# EasyEDA Pro project NFC1.eprj (continued)
## Text on the board (continued)
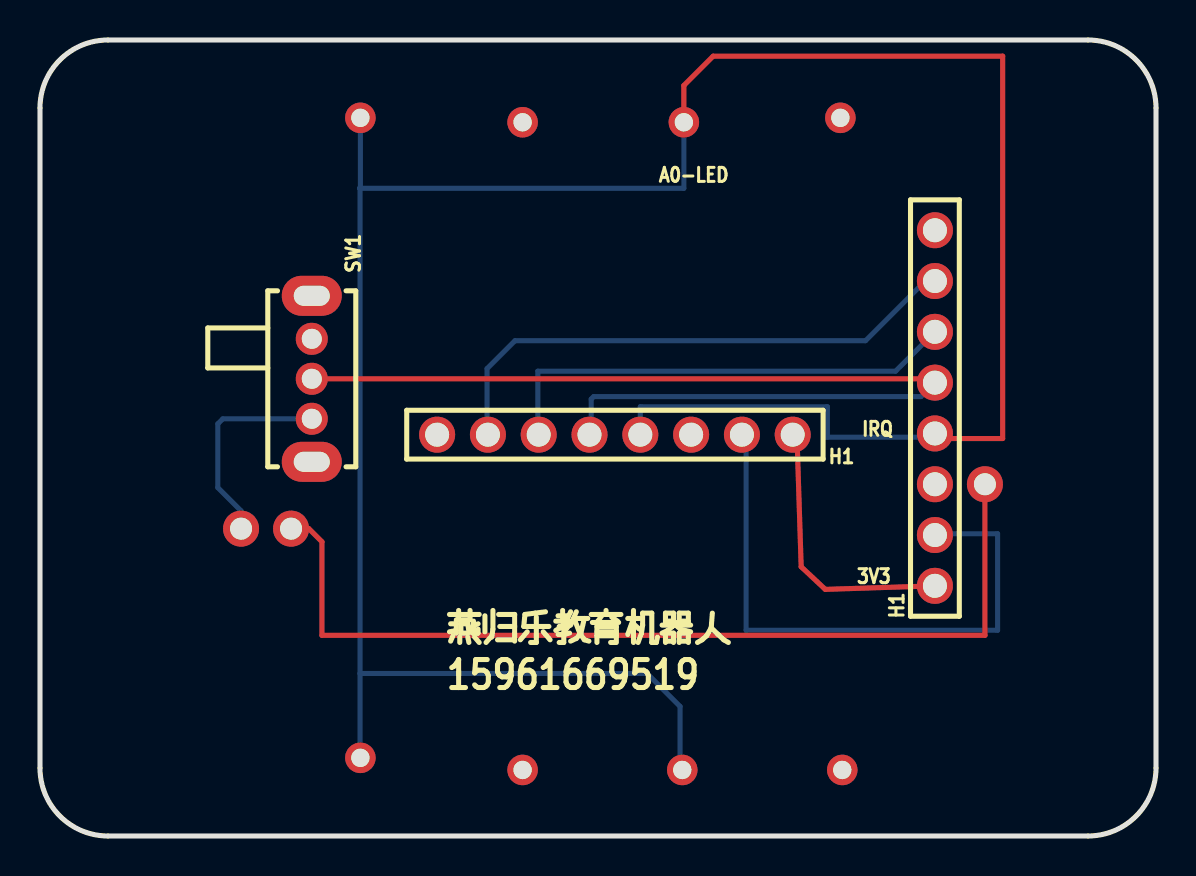
[diagram p2: board, top side]
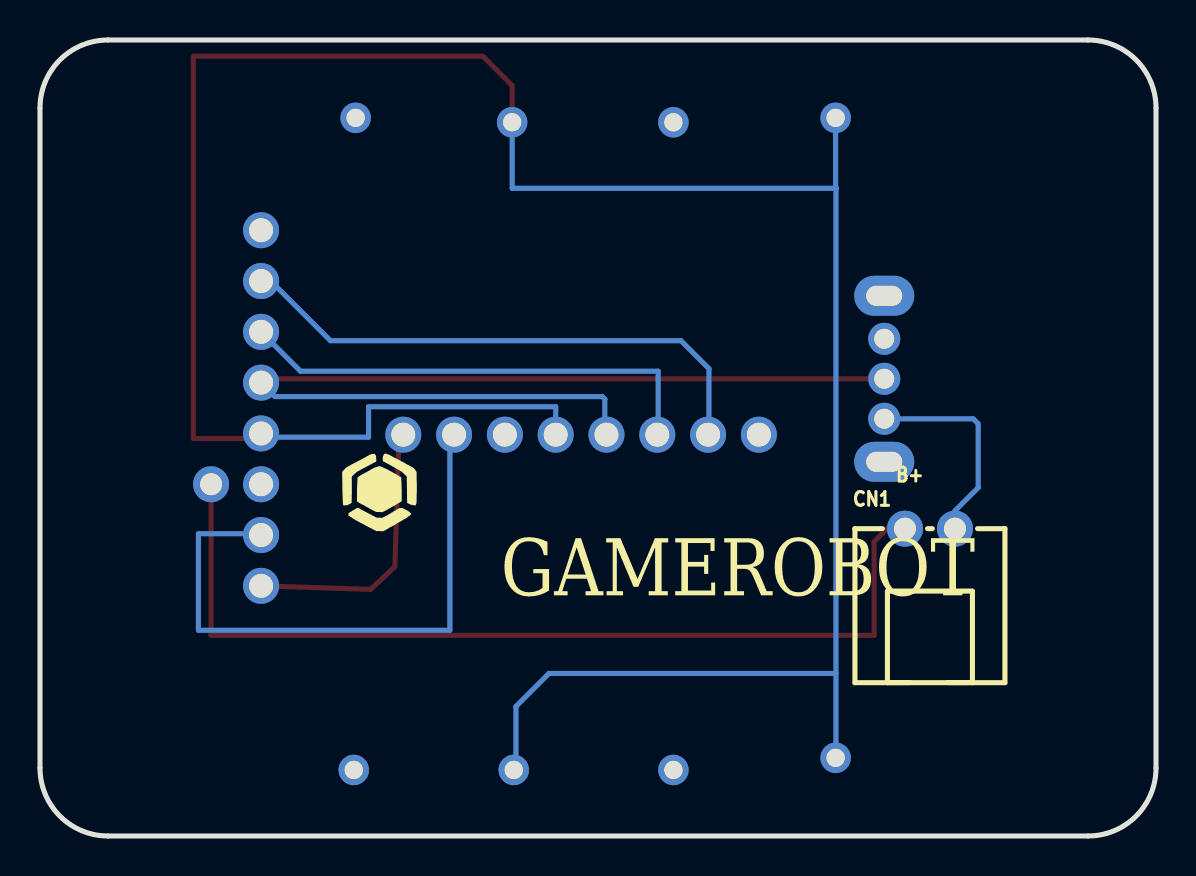
[diagram p3: board, bottom side, seen from below]

Outline 55.8 x 39.8 mm; copper layers: Top Layer, Bottom Layer. Coordinates in mm from the lower left corner of the outline.
Outline path: 0,36.4 0,3.4 arc(1,1) 3.4,0 52.4,0 arc(54.8,1) 55.8,3.4 55.8,36.4 arc(54.8,38.8) 52.4,39.8 3.4,39.8 arc(1,38.8) 0,36.4
Stack: Top Layer 0.035mm / Dielectric1 1.51mm FR4 er 4.5 / Bottom Layer 0.035mm

## Design rules (mm)
template: JLCPCB Capability(Two Layers Board)
spacing copperThickness1oz (default): track to track 0.102, other pairs 0.152 to 0.3
spacing copperThickness2oz: track to track 0.203, other pairs 0.152 to 0.3
track width copperThickness1oz (default): min 0.127, default 0.254, max 2.54
track width copperThickness2oz: min 0.203, default 0.254, max 2.54
differential pair differentialPair (default): width min 0.127, default 0.254, max 2.54; gap min 0.152, default 0.152
via viaSize (default): diameter min 0.5, default 0.61, max 10; hole min 0.3, default 0.305, max 6.3

## Placement (name value [footprint] x y rotation side)
CN1  -  [CONN-TH_2P-P2.50_HX25003-2WAP]  11.3 15.37 180 bottom
H1  -  [hdr-th_8p-p2.54-v-f-1]  44.75 21.4 90 top
H1#2  -  [hdr-th_8p-p2.54-v-f-1]  28.75 20.07 180 top
NOREF  -  [Pad_e33]  32.11 3.3 0 top
NOREF#2  -  [Pad_e17]  40.11 3.3 0 top
NOREF#3  -  [Pad_e133]  47.25 17.59 180 top
NOREF#4  -  [Pad_e28]  16.02 3.91 0 top
NOREF#5  -  [Pad_e25]  24.13 35.69 0 top
NOREF#6  -  [Pad_e4]  16.02 35.91 0 top
NOREF#7  -  [Pad_e27]  24.13 3.3 0 top
NOREF#8  -  [Pad_e26]  32.19 35.69 0 top
NOREF#9  -  [Pad_e2]  40.02 35.91 0 top
SW1  -  [拨动开关_侧]  13.59 22.86 270 top

## Footprints (pads in the part's own frame, mm; a bottom-side part is the same pattern mirrored in y, then rotated)
CONN-TH_2P-P2.50_HX25003-2WAP
  round 1.8 hole 1.1: 1(-1.25,0) 2(1.25,0)
hdr-th_8p-p2.54-v-f-1
  round 1.8 hole 1.2: 1(-8.89,0) 2(-6.35,0) 3(-3.81,0) 4(-1.27,0) 5(1.27,0) 6(3.81,0) 7(6.35,0) 8(8.89,0)
Pad_e2
  round 1.524 hole 0.914: 1(0,0)
Pad_e4
  round 1.524 hole 0.914: 2(0,0)
Pad_e17
  round 1.524 hole 0.914: 1(0,0)
Pad_e25
  round 1.524 hole 0.914: 1(0,0)
Pad_e26
  round 1.524 hole 0.914: 2(0,0)
Pad_e27
  round 1.524 hole 0.914: 3(0,0)
Pad_e28
  round 1.524 hole 0.914: 4(0,0)
Pad_e33
  round 1.524 hole 0.914: 4(0,0)
Pad_e133
  round 1.8 hole 1.1: 1(0,0)
拨动开关_侧
  oval 1.6x1.6 hole 1.001: 1(-1.999,0) 2(0,0) 3(1.999,0)
  oval 1.999x2.999 hole 1.001x1.801: 4(4.151,0) 5(-4.151,0)

## Nets
3V3: H1.1 H1#2.1
GND: H1.3 H1#2.3 NOREF#2.1 NOREF#5.1 NOREF#7.3 NOREF#9.1
B+: CN1.1 NOREF#3.1
GGG: CN1.2 SW1.3
IRQ: H1.4 H1#2.4 NOREF.4 NOREF#4.4 NOREF#6.2 NOREF#8.2
RST: H1.2 H1#2.2
SCK: H1.7 H1#2.7
SDA: H1.8 H1#2.8
SI: H1.6 H1#2.6
SO: H1.5 H1#2.5 SW1.2

Pads without a net: SW1 1 4 5

## Routing (per net, layer and track width the routed paths; a pad name or vN(x,y) marks a point on that pad's centre or on a via; arc(x,y) is an arc through that point)
3V3: length 13.7
  Top Layer w0.254: H1.1 39.27,12.33 38.06,13.46 37.85,20.07
B+: length 47.2
  Top Layer w0.254: CN1.1 13.44,15.37 14.1,14.71 14.1,10.03 47.25,10.03 NOREF#3.1
GGG: length 10.5
  Bottom Layer w0.254: CN1.2 10.05,16.26 8.89,17.42 8.89,20.61 9.14,20.86 13.59,20.86
IRQ: length 130.1
  Top Layer w0.254: NOREF#8.2 32.19,37.53 33.65,38.99 48.13,38.99 48.13,19.87 44.75,19.87
  Bottom Layer w0.254: H1#2.4 30.02,21.46 39.37,21.46 39.37,19.94 44.56,19.94 H1.4 ; NOREF#8.2 32.19,32.38 15.98,32.38 ; 16,8.13 16,32.37 15.98,32.38 ; 16,8.13 16,3.92 NOREF#4.4 ; 16,8.13 30.35,8.13 32,6.48 32,3.41 NOREF.4 ; NOREF#6.2 16.02,32.42 15.98,32.38
RST: length 30.3
  Bottom Layer w0.254: 35.31,20.07 35.31,10.29 47.88,10.29 47.88,15.11 44.81,15.11 H1.2
SCK: length 27.5
  Bottom Layer w0.254: H1#2.7 22.35,20.11 22.35,23.37 23.75,24.77 41.27,24.77 44.26,27.75 H1.7
SI: length 23.9
  Bottom Layer w0.254: H1#2.6 24.89,20.11 24.89,23.24 42.78,23.24 H1.6
SO: length 50.6
  Top Layer w0.254: SW1.2 44.55,22.86 H1.5
  Bottom Layer w0.254: H1.5 44.05,21.97 27.69,21.97 27.56,21.84 27.56,20.15 H1#2.5

## Text on the board
Bottom Silkscreen Layer: B+ | GAMEROBOT
Top Silkscreen Layer: A0-LED | 3V3 | IRQ | 燕归乐教育机器人 / 15961669519

# Board 电机驱动ASCII8833-3
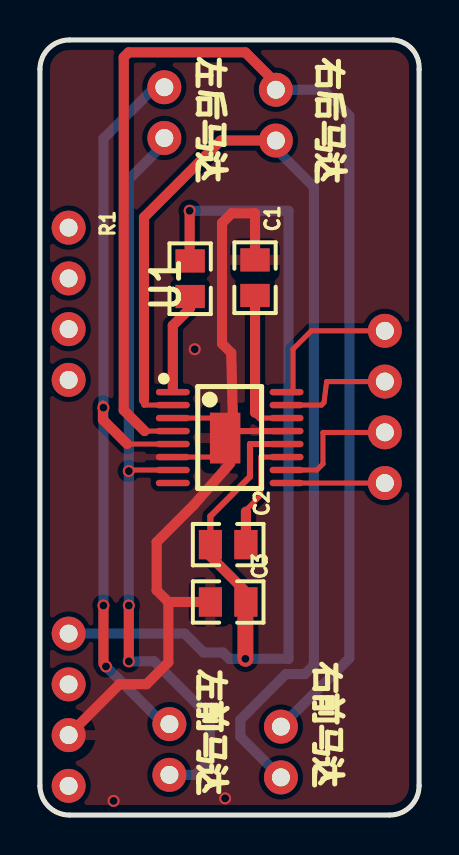
[diagram p4: board, top side]
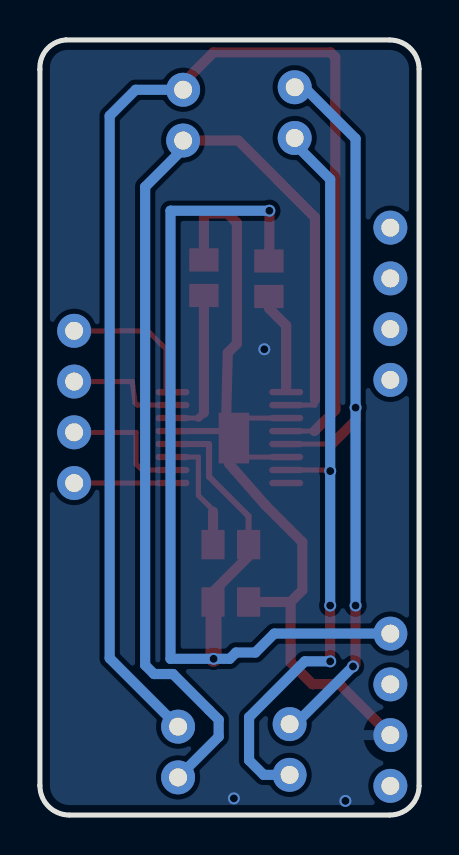
[diagram p5: board, bottom side, seen from below]

Outline 19 x 38.8 mm; copper layers: Top Layer, Bottom Layer. Coordinates in mm from the lower left corner of the outline.
Outline path: 0,37.32 arc(0.43,38.36) 1.47,38.8 ; 0,37.32 arc(0.43,38.36) 1.47,38.8 ; 0,37.32 0,1.47 ; 0,37.32 0,1.47 ; 1.47,38.8 17.7,38.8 ; 1.47,38.8 17.7,38.8 ; 0,1.47 arc(0.43,0.43) 1.47,0 ; 0,1.47 arc(0.43,0.43) 1.47,0 ; 17.7,38.8 arc(18.65,38.33) 19,37.32 ; 17.7,38.8 arc(18.65,38.33) 19,37.32 ; 1.47,0 17.53,0 ; 1.47,0 17.53,0 ; 17.53,0 arc(18.57,0.43) 19,1.47 ; 17.53,0 arc(18.57,0.43) 19,1.47 ; 19,37.32 19,1.47 ; 19,37.32 19,1.47
Stack: Top Layer 0.0356mm / Dielectric1 0.32mm FR-4 er 4.8 / Bottom Layer 0.0356mm

## Design rules (mm)
spacing Clearance (default): track to track 0.254, other pairs 0 to 0.254
track width Width (default): min 0.254, default 0.508, max 1.27
differential pair DiffPairsRouting (default): width min 0.381, default 0.381, max 0.381; gap min 0.254, default 0.254
via RoutingVias (default): diameter min 1.27, default 1.27, max 1.27; hole min 0.711, default 0.711, max 0.711

## Placement (name value [footprint] x y rotation side)
C1  -  [0805_R]  10.78 26.89 270 top
C2  -  [0805_R]  9.43 13.53 0 top
C3  -  [0805_R]  9.43 10.66 0 top
NOREF  -  [Pad_ie7]  11.82 33.76 270 top
NOREF#2  -  [Pad_ie11]  17.28 24.24 270 top
NOREF#3  -  [Pad_ie16]  1.44 4 270 top
NOREF#4  -  [Pad_ie13]  17.28 19.16 270 top
NOREF#5  -  [Pad_ie189]  1.44 26.86 270 top
NOREF#6  -  [Pad_ie17]  1.44 6.54 270 top
NOREF#7  -  [Pad_ie3]  6.49 4.55 270 top
NOREF#8  -  [Pad_ie15]  1.44 1.46 270 top
NOREF#9  -  [Pad_ie18]  1.44 9.08 270 top
NOREF#10  -  [Pad_ie2]  1.44 24.32 270 top
NOREF#11  -  [Pad_ie4]  6.49 2.01 270 top
NOREF#12  -  [Pad_ie190]  1.44 29.4 270 top
NOREF#13  -  [Pad_ie8]  11.82 36.3 270 top
NOREF#14  -  [Pad_ie21]  9.28 18.87 0 top
NOREF#15  -  [Pad_ie14]  17.28 16.62 270 top
NOREF#16  -  [Pad_ie6]  12.07 1.88 270 top
NOREF#17  -  [Pad_ie9]  6.23 33.89 270 top
NOREF#18  -  [Pad_ie1]  1.44 21.78 270 top
NOREF#19  -  [Pad_ie12]  17.28 21.7 270 top
NOREF#20  -  [Pad_ie10]  6.23 36.43 270 top
NOREF#21  -  [Pad_ie5]  12.07 4.42 270 top
R1  -  [0805_R]  7.53 26.84 270 top
U1  -  [TSSOP-16]  9.51 18.89 270 top

## Footprints (pads in the part's own frame, mm; a bottom-side part is the same pattern mirrored in y, then rotated)
0805_R
  rect 1.16x1.47 smd: 1(-0.89,0) 2(0.89,0)
Pad_ie1
  round 1.7 hole 0.9: 0(0,0)
Pad_ie2
  round 1.7 hole 0.9: 0(0,0)
Pad_ie3
  round 1.7 hole 0.9: 0(0,0)
Pad_ie4
  round 1.7 hole 0.9: 0(0,0)
Pad_ie5
  round 1.7 hole 0.9: 0(0,0)
Pad_ie6
  round 1.7 hole 0.9: 0(0,0)
Pad_ie7
  round 1.7 hole 0.9: 0(0,0)
Pad_ie8
  round 1.7 hole 0.9: 0(0,0)
Pad_ie9
  round 1.7 hole 0.9: 0(0,0)
Pad_ie10
  round 1.7 hole 0.9: 0(0,0)
Pad_ie11
  round 1.7 hole 0.9: 0(0,0)
Pad_ie12
  round 1.7 hole 0.9: 0(0,0)
Pad_ie13
  round 1.7 hole 0.9: 0(0,0)
Pad_ie14
  round 1.7 hole 0.9: 0(0,0)
Pad_ie15
  round 1.7 hole 0.9: 0(0,0)
Pad_ie16
  round 1.7 hole 0.9: 0(0,0)
Pad_ie17
  round 1.7 hole 0.9: 0(0,0)
Pad_ie18
  round 1.7 hole 0.9: 0(0,0)
Pad_ie21
  rect 1.524x2.54 smd: 1(0,0)
Pad_ie189
  round 1.7 hole 0.9: 0(0,0)
Pad_ie190
  round 1.7 hole 0.9: 0(0,0)
TSSOP-16
  oval 0.32x1.7 smd: 1(-2.275,-2.85) 2(-1.625,-2.85) 3(-0.975,-2.85) 4(-0.325,-2.85) 5(0.325,-2.85) 6(0.975,-2.85) 7(1.625,-2.85) 8(2.275,-2.85) 9(2.275,2.85) 10(1.625,2.85) 11(0.975,2.85) 12(0.325,2.85) 13(-0.325,2.85) 14(-0.975,2.85) 15(-1.625,2.85) 16(-2.275,2.85)

## Nets
GND: C1.1 C3.1 NOREF#3.0 NOREF#14.1 U1.3 U1.6 U1.13
VCC: C2.1 C3.2 NOREF#9.0 R1.1 U1.12

Pads without a net: C1 2; C2 2; NOREF 0; NOREF#2 0; NOREF#4 0; NOREF#5 0; NOREF#6 0; NOREF#7 0; NOREF#8 0; NOREF#10 0; NOREF#11 0; NOREF#12 0; NOREF#13 0; NOREF#15 0; NOREF#16 0; NOREF#17 0; NOREF#18 0; NOREF#19 0; NOREF#20 0; NOREF#21 0; R1 2; U1 1 2 4 5 7 8 9 10 11 14 15 16

## Via types
v1: diameter 0.6, hole 0.4, Top Layer to Bottom Layer, 11 vias

## Routing (per net, layer and track width the routed paths; a pad name or vN(x,y) marks a point on that pad's centre or on a via; arc(x,y) is an arc through that point)
GND: length 40.9
  Top Layer w0.254: U1.6 8.77,17.92 ; U1.3 8.77,19.87
  Top Layer w0.305: 9.79,19.22 U1.13
  Top Layer w0.508: C1.1 10.78,30.12 9.61,30.12 9.13,29.64 9.13,23.59 9.58,23.14 9.66,20.14 ; 6.43,10.66 6.43,7.64 5.34,6.55 3.99,6.55 NOREF#3.0 ; 6.43,10.66 C3.1 ; 6.43,10.66 5.85,11.25 5.85,13.66 7.7,15.52 9.53,17.6
  vias: v1(3.69,0.71) v1(7.75,23.31) v1(9.28,0.83)
VCC: length 53.4
  Top Layer w0.305: C2.1 8.54,14.96 10.52,16.94 10.52,18.57 11.69,18.57
  Top Layer w0.508: 8.54,12.95 10.32,11.17 ; 7.5,27.68 v1(7.5,30.25)
  Top Layer w0.8: v1(10.29,7.82) 10.29,10.23
  Bottom Layer w0.508: v1(7.5,30.25) 12.45,30.25 12.45,7.82 v1(10.29,7.82) 9.49,7.82 9.17,8.14 8.2,8.14 7.26,9.08 NOREF#9.0
(no net): length 242.8
  Top Layer w0.254: 10.4,15.34 11.06,16 11.06,17.92 U1.11 ; 5.21,20.77 5.21,20.52 U1.2 ; 17.28,19.15 14.18,19.15 14.18,17.57 13.88,17.27 U1.10 ; 16.61,21.7 16.95,21.36 NOREF#19.0 14.37,21.7 14.23,20.65 14.11,20.52 U1.15 ; 11.05,19.87 U1.14 ; 7.53,25.37 R1.2 ; 4.45,17.27 U1.7 ; 16.77,18.63 17.1,18.63 ; 12.64,16.62 NOREF#15.0 ; 5.25,19.22 U1.4 ; 4.37,18.57 U1.5 ; NOREF#2.0 13.6,24.24 12.68,23.32 12.68,21.13
  Top Layer w0.381: 10.78,20.14 11.05,19.87
  Top Layer w0.508: 11.82,36.27 NOREF#13.0 11.82,36.65 10.29,38.17 4.44,38.17 4.2,37.93 4.2,20.27 5.25,19.22 ; 10.78,20.14 C1.2 ; 5.21,20.77 5.21,29.92 9.06,33.76 NOREF.0 ; 6.66,21.28 6.66,24.5 7.53,25.37 ; 3.16,20.49 3.16,19.78 4.37,18.57 ; 3.18,7.57 v1(3.18,10.49) ; v1(4.45,7.69) v1(4.45,10.49) ; C2.2 10.32,15.19
  Bottom Layer w0.254: 17.39,16.46 17.43,16.46 17.6,16.45 17.76,16.43 17.93,16.4
  Bottom Layer w0.508: NOREF#21.0 15.5,7.85 15.5,35 14.2,36.3 NOREF#13.0 ; v1(4.45,10.49) 4.45,31.82 6.23,33.6 NOREF#17.0 ; NOREF#16.0 10.04,3.92 10.04,4.77 12.33,7.06 13.28,7.06 13.72,7.5 13.72,31.44 11.82,33.34 NOREF.0 ; NOREF#20.0 5.76,36.43 3.18,33.85 3.18,10.74 ; NOREF#11.0 7.79,2.01 8.52,2.74 8.52,4.9 5.72,7.69 v1(4.45,7.69) ; v1(3.31,7.44) 6.2,4.55 NOREF#7.0
  vias: v1(3.18,20.39) v1(4.45,17.22)

## Copper pours and planes (outline as drawn; the poured copper is in the pictures)
GND on Top Layer: -1.14,39.82 19.95,39.82 19.95,-1.32 -1.14,-1.32
GND on Bottom Layer: -0.5,39.19 19.57,39.19 19.57,-0.94 -0.5,-0.94

## Text on the board
Top Silkscreen Layer: 左后马达 | 左前马达 | 右前马达 | 右后马达

# Board 麦克轮驱动
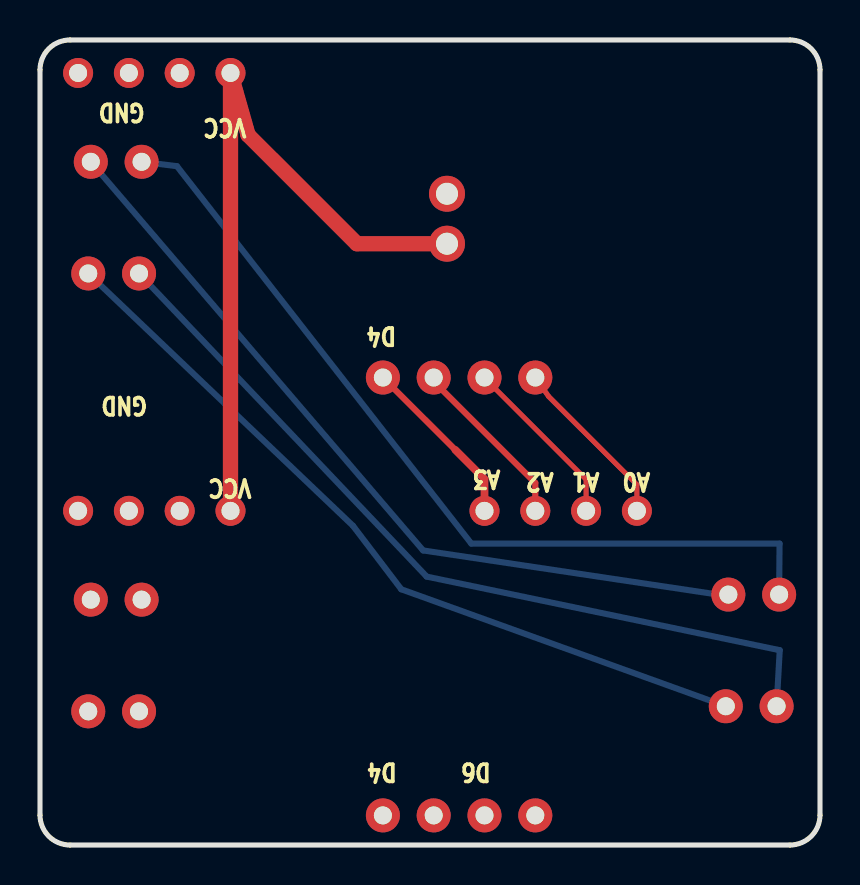
[diagram p6: board, top side]
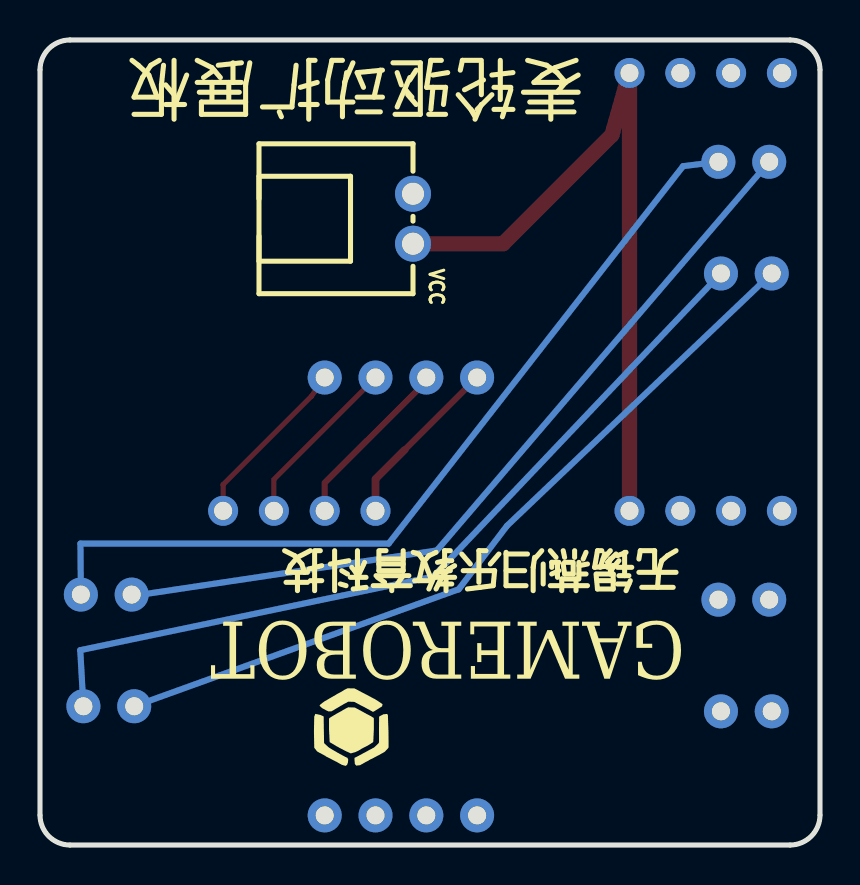
[diagram p7: board, bottom side, seen from below]

Outline 39 x 40.28 mm; copper layers: Top Layer, Bottom Layer. Coordinates in mm from the lower left corner of the outline.
Outline path: 0,38.78 0,1.5 arc(0.44,0.44) 1.5,0 37.5,0 arc(38.56,0.44) 39,1.5 39,38.78 arc(38.56,39.85) 37.5,40.28 1.5,40.28 arc(0.44,39.85) 0,38.78
Stack: Top Layer 0.035mm / Dielectric1 1.51mm FR4 er 4.5 / Bottom Layer 0.035mm

## Design rules (mm)
template: JLCPCB Capability(Two Layers Board)
spacing copperThickness1oz (default): track to track 0.102, other pairs 0.152 to 0.3
spacing copperThickness2oz: track to track 0.203, other pairs 0.152 to 0.3
track width copperThickness1oz (default): min 0.127, default 0.254, max 2.54
track width copperThickness2oz: min 0.203, default 0.254, max 2.54
differential pair differentialPair (default): width min 0.127, default 0.254, max 2.54; gap min 0.152, default 0.152
via viaSize (default): diameter min 0.5, default 0.61, max 10; hole min 0.3, default 0.305, max 6.3

## Placement (name value [footprint] x y rotation side)
NOREF  -  [Pad_ie1]  34.42 12.53 180 top
NOREF#2  -  [Pad_e359]  6.99 38.63 0 top
NOREF#3  -  [Pad_ie5]  22.23 1.48 180 top
NOREF#4  -  [Pad_ie0]  36.96 12.53 180 top
NOREF#5  -  [Pad_ie9]  2.41 6.69 180 top
NOREF#6  -  [Pad_ie3]  34.29 6.94 180 top
NOREF#7  -  [Pad_ie17]  22.23 23.39 180 top
NOREF#8  -  [Pad_ie2]  36.83 6.94 180 top
NOREF#9  -  [Pad_e360]  9.53 38.63 0 top
NOREF#10  -  [Pad_e11]  9.53 16.72 0 top
NOREF#11  -  [Pad_e15]  24.77 16.72 0 top
NOREF#12  -  [Pad_e8]  1.91 16.72 0 top
NOREF#13  -  [Pad_ie22]  5.08 34.19 180 top
NOREF#14  -  [Pad_ie18]  19.69 23.39 180 top
NOREF#15  -  [Pad_e14]  22.23 16.72 0 top
NOREF#16  -  [Pad_ie16]  24.77 23.39 180 top
NOREF#17  -  [Pad_e17]  29.84 16.72 0 top
NOREF#18  -  [Pad_ie23]  2.54 34.19 180 top
NOREF#19  -  [Pad_ie10]  5.08 12.28 180 top
NOREF#20  -  [Pad_e357]  1.91 38.63 0 top
NOREF#21  -  [Pad_e10]  6.99 16.72 0 top
NOREF#22  -  [Pad_ie7]  17.15 1.48 180 top
NOREF#23  -  [Pad_e16]  27.31 16.72 0 top
NOREF#24  -  [Pad_ie21]  2.41 28.6 180 top
NOREF#25  -  [Pad_ie19]  17.15 23.39 180 top
NOREF#26  -  [Pad_e358]  4.45 38.63 0 top
NOREF#27  -  [Pad_ie20]  4.95 28.6 180 top
NOREF#28  -  [Pad_ie8]  4.95 6.69 180 top
NOREF#29  -  [Pad_ie11]  2.54 12.28 180 top
NOREF#30  -  [Pad_ie6]  19.69 1.48 180 top
NOREF#31  -  [Pad_ie4]  24.77 1.48 180 top
NOREF#32  -  [Pad_e9]  4.45 16.72 0 top
VCC  -  [CONN-TH_2P-P2.50_HX25003-2WAP]  20.35 31.34 270 bottom

## Footprints (pads in the part's own frame, mm; a bottom-side part is the same pattern mirrored in y, then rotated)
CONN-TH_2P-P2.50_HX25003-2WAP
  round 1.8 hole 1.1: 1(-1.25,0) 2(1.25,0)
Pad_e8
  round 1.5 hole 0.9: 7(0,0)
Pad_e9
  round 1.5 hole 0.9: 8(0,0)
Pad_e10
  round 1.5 hole 0.9: 9(0,0)
Pad_e11
  round 1.5 hole 0.9: 10(0,0)
Pad_e14
  round 1.5 hole 0.9: 9(0,0)
Pad_e15
  round 1.5 hole 0.9: 9(0,0)
Pad_e16
  round 1.5 hole 0.9: 9(0,0)
Pad_e17
  round 1.5 hole 0.9: 9(0,0)
Pad_e357
  round 1.5 hole 0.9: 7(0,0)
Pad_e358
  round 1.5 hole 0.9: 8(0,0)
Pad_e359
  round 1.5 hole 0.9: 9(0,0)
Pad_e360
  round 1.5 hole 0.9: 10(0,0)
Pad_ie0
  round 1.7 hole 0.9: 0(0,0)
Pad_ie1
  round 1.7 hole 0.9: 0(0,0)
Pad_ie2
  round 1.7 hole 0.9: 0(0,0)
Pad_ie3
  round 1.7 hole 0.9: 0(0,0)
Pad_ie4
  round 1.7 hole 0.9: 0(0,0)
Pad_ie5
  round 1.7 hole 0.9: 0(0,0)
Pad_ie6
  round 1.7 hole 0.9: 0(0,0)
Pad_ie7
  round 1.7 hole 0.9: 0(0,0)
Pad_ie8
  round 1.7 hole 0.9: 0(0,0)
Pad_ie9
  round 1.7 hole 0.9: 0(0,0)
Pad_ie10
  round 1.7 hole 0.9: 0(0,0)
Pad_ie11
  round 1.7 hole 0.9: 0(0,0)
Pad_ie16
  round 1.7 hole 0.9: 0(0,0)
Pad_ie17
  round 1.7 hole 0.9: 0(0,0)
Pad_ie18
  round 1.7 hole 0.9: 0(0,0)
Pad_ie19
  round 1.7 hole 0.9: 0(0,0)
Pad_ie20
  round 1.7 hole 0.9: 0(0,0)
Pad_ie21
  round 1.7 hole 0.9: 0(0,0)
Pad_ie22
  round 1.7 hole 0.9: 0(0,0)
Pad_ie23
  round 1.7 hole 0.9: 0(0,0)

## Nets
GND: NOREF#26.8 NOREF#32.8 VCC.1
VCC: NOREF#9.10 NOREF#10.10 VCC.2
5: NOREF#22.0
6: NOREF#30.0
7: NOREF#3.0
8: NOREF#31.0
A0: NOREF#16.0 NOREF#17.9
A1: NOREF#7.0 NOREF#23.9
A2: NOREF#11.9 NOREF#14.0
A3: NOREF#15.9 NOREF#25.0

Pads without a net: NOREF 0; NOREF#2 9; NOREF#4 0; NOREF#5 0; NOREF#6 0; NOREF#8 0; NOREF#12 7; NOREF#13 0; NOREF#18 0; NOREF#19 0; NOREF#20 7; NOREF#21 9; NOREF#24 0; NOREF#27 0; NOREF#28 0; NOREF#29 0

## Routing (per net, layer and track width the routed paths; a pad name or vN(x,y) marks a point on that pad's centre or on a via; arc(x,y) is an arc through that point)
VCC: length 37.3
  Top Layer w0.762: VCC.2 15.84,30.09 10.41,35.53 NOREF#9.10 NOREF#10.10
(no net): length 166
  Bottom Layer w0.305: NOREF#27.0 19.33,13.43 36.99,9.75 NOREF#8.0 ; NOREF#18.0 19.16,14.74 34.33,12.47 NOREF.0 ; NOREF#13.0 6.85,33.97 21.57,15.08 36.98,15.08 NOREF#4.0 ; NOREF#6.0 18.06,12.8 15.65,15.97 NOREF#24.0
A0: length 8.7
  Top Layer w0.254: NOREF#17.9 29.84,18.03 25.43,22.45 NOREF#16.0
A1: length 8.8
  Top Layer w0.254: NOREF#23.9 27.31,18.29 22.23,23.37 NOREF#7.0
A2: length 8.8
  Top Layer w0.305: NOREF#11.9 24.77,18.12 19.69,23.2 NOREF#14.0
A3: length 8.8
  Top Layer w0.305: 20.77,19.77 NOREF#25.0
  Top Layer w0.381: NOREF#15.9 22.23,18.31 20.77,19.77

## Copper pours and planes (outline as drawn; the poured copper is in the pictures)
GND on Top Layer: -0.73,40.99 40.04,40.99 40.04,-0.79 -0.73,-0.79
GND on Bottom Layer: -0.86,41.5 39.65,41.5 39.65,-0.54 -0.86,-0.54

## Text on the board
Bottom Silkscreen Layer: 无锡燕归乐教育科技 | 麦轮驱动扩展板 | GAMEROBOT
Top Silkscreen Layer: GND | VCC | D4 | D6 | A3 | A2 | A1 | A0
